# Altium schematic sheet Power.SchDoc
size OrCAD C; SheetNumber: 2; SheetTotal: 5
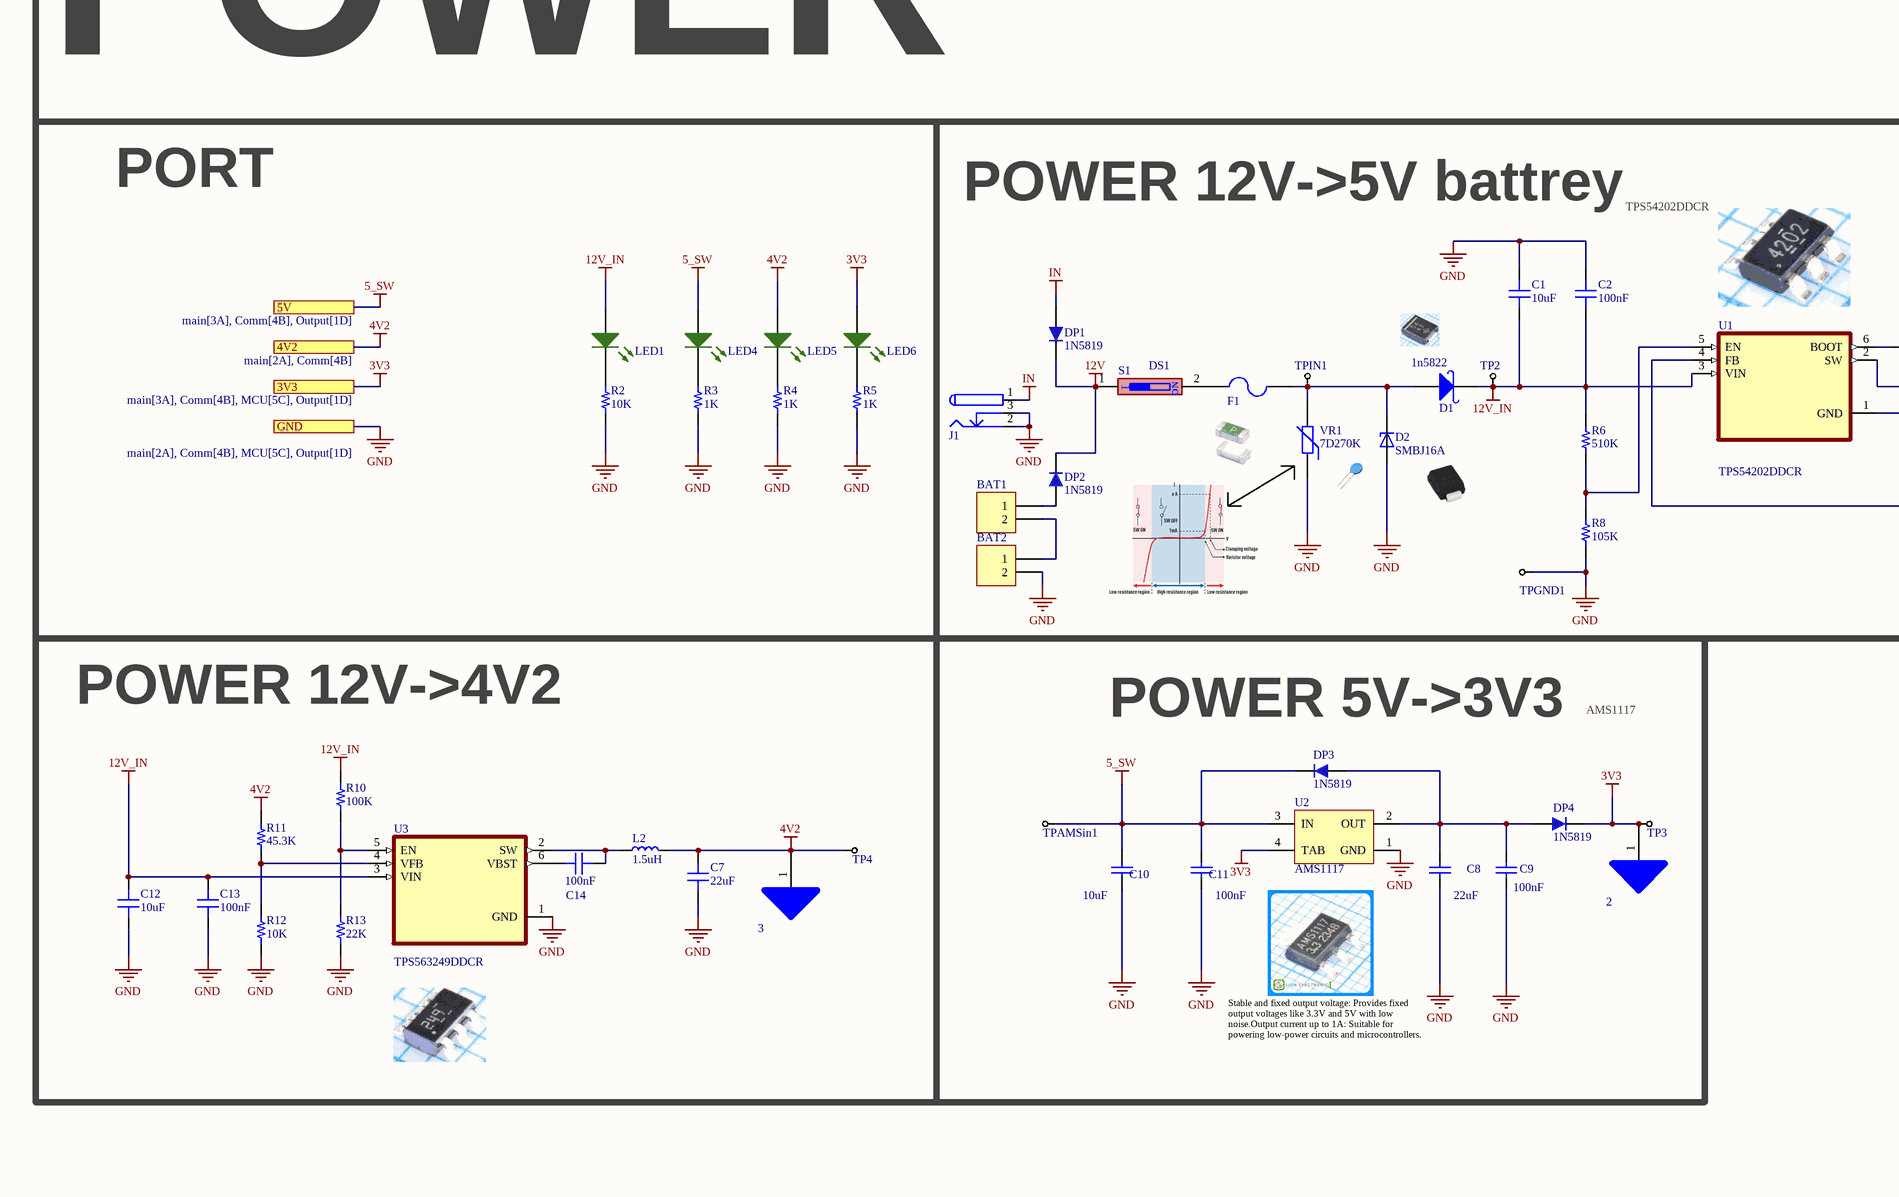
[diagram p0: Power.SchDoc, left]
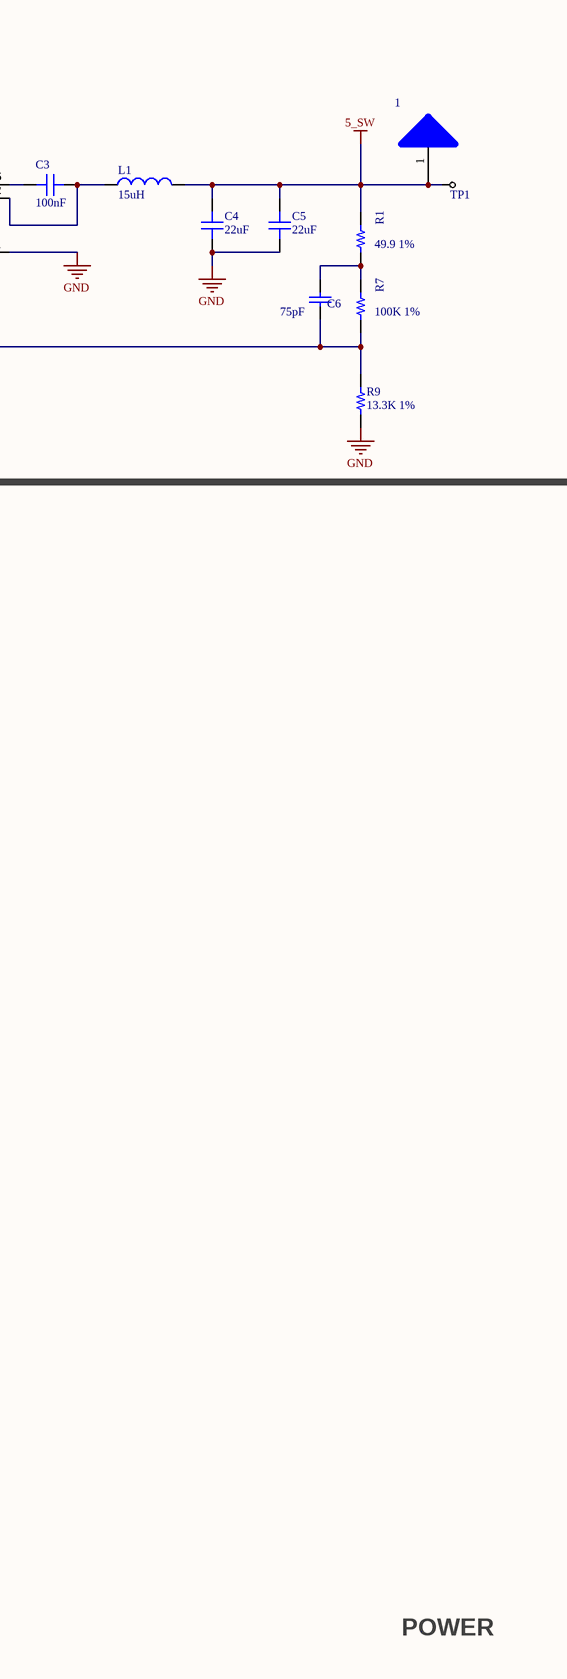
[diagram p1: Power.SchDoc, right]

## Parts
1  (no value)  [MY_TestPin]
2  (no value)  [MY_TestPin]
3  (no value)  [MY_TestPin]
BAT1  Header 2  [My_1X02]  (value not drawn)
BAT2  Header 2  [My_1X02]  (value not drawn)
C1  10uF  [CAP 0603_1608]
C2  100nF  [CAP 0603_1608]
C3  100nF  [CAP 0603_1608]
C4  22uF  [CAP 0603_1608]
C5  22uF  [CAP 0603_1608]
C6  75pF  [MY_CAP_SMD_0603]
C7  22uF  [CAP 0603_1608]
C8  22uF  [MY_CAP_SMD_0603]
C9  100nF  [MY_CAP_SMD_0603]
C10  10uF  [MY_CAP_SMD_0603]
C11  100nF  [MY_CAP_SMD_0603]
C12  10uF  [CAP 0603_1608]
C13  100nF  [CAP 0603_1608]
C14  100nF  [CAP 0603_1608]
D1  1n5822  [DO-214AB(SMC)]
D2  SMBJ16A  [DIOM4336X265N]
DP1  1N5819  [430X270D]
DP2  1N5819  [430X270D]
DP3  1N5819  [430X270D]
DP4  1N5819  [430X270D]
F1  F=3.0 A  [1206 FUSE]  (value not drawn)
J1  DC Power Jack  [DC Power Jack 1]  (value not drawn)
L1  15uH  [INDUCTOR_SMD_3A]
L2  1.5uH  [IND 7X7MM]
LED1  LED SMD 1206 GREEN  [LED_1206_GREEN]  (value not drawn)
LED4  LED SMD 1206 GREEN  [LED_1206_GREEN]  (value not drawn)
LED5  LED SMD 1206 GREEN  [LED_1206_GREEN]  (value not drawn)
LED6  LED SMD 1206 GREEN  [LED_1206_GREEN]  (value not drawn)
R1  49.9 1%  [RES 0805_2012]
R2  10K  [RES 0603_1608]
R3  1K  [RES 0603_1608]
R4  1K  [RES 0603_1608]
R5  1K  [RES 0603_1608]
R6  510K  [RES 0603_1608]
R7  100K 1%  [RES 0805_2012]
R8  105K  [RES 0603_1608]
R9  13.3K 1%  [RES 0603_1608]
R10  100K  [RES 0603_1608]
R11  45.3K  [RES 0603_1608]
R12  10K  [RES 0603_1608]
R13  22K  [RES 0603_1608]
S1  DS1  [DIP Switch x1]
TP1  Test Point  [Test Point]  (value not drawn)
TP2  Test Point  [Test Point]  (value not drawn)
TP3  Test Point  [Test Point]  (value not drawn)
TP4  Test Point  [Test Point]  (value not drawn)
TPAMSin1  Test Point  [Test Point]  (value not drawn)
TPGND1  Test Point  [Test Point]  (value not drawn)
TPIN1  Test Point  [Test Point]  (value not drawn)
U1  TPS54202DDCR  [SOT95P280X110-6N]
U2  AMS1117  [SOT223_M]
U3  TPS563249DDCR  [SOT95P280X110-6N]
VR1  7D270K  [07D XXX]

## Blocks framed on the sheet
POWER: LED1 LED4-LED6 R2-R5
POWER 12V->5V battrey: 1 BAT1 BAT2 C1-C6 D1 D2 DP1 DP2 F1 J1 L1 R1 R6-R9 S1 TP1 TP2 TPGND1 TPIN1 U1 VR1
POWER 12V->4V2: 3 C7 C12-C14 L2 R10-R13 TP4 U3
POWER 5V->3V3: 2 C8-C11 DP3 DP4 TP3 TPAMSin1 U2

## Ports
3V3 (see main[3A], Comm[4B], MCU[5C], Output[1D]), 4V2 (see main[2A], Comm[4B]), 5V (see main[3A], Comm[4B], Output[1D]), GND (see main[2A], Comm[4B], MCU[5C], Output[1D])

## Nets
3V3: 2.1 DP4.2 LED6.1(A) TP3.1(T) U2.4(TAB) ; port 3V3
4V2: 3.1 C7.2 L2.2 LED5.1(A) R11.2 TP4.1(T) ; port 4V2
5_SW: 1.1 C4.2 C5.2 C10.1 C11.1 DP3.2 L1.2 LED4.1(A) R1.1 TP1.1(T) TPAMSin1.1(T) U2.3(IN) ; port 5V
12V: DP1.2 DP2.2 S1.1
12V_IN: C1.1 C2.1 C12.2 C13.2 D1.2(K) LED1.1(A) R6.2 R10.2 TP2.1(T) U1.3(VIN) U3.3(VIN)
GND: BAT2.2 C1.2 C2.2 C4.1 C5.1 C7.1 C8.2 C9.2 C10.2 C11.2 C12.1 C13.1 D2.A J1.2 J1.3 R2.1 R3.1 R4.1 R5.1 R8.1 R9.1 R12.1 R13.1 TPGND1.1(T) U1.1(GND) U2.1(GND) U3.1(GND) VR1.1 ; port GND
IN: DP1.1 J1.1
NetBAT1_1: BAT1.1 DP2.1
NetBAT1_2: BAT1.2 BAT2.1
NetC3_1: C3.1 L1.1 U1.2(SW)
NetC3_2: C3.2 U1.6(BOOT)
NetC6_1: C6.1 R1.2 R7.1
NetC6_2: C6.2 R7.2 R9.2 U1.4(FB)
NetC8_1: C8.1 C9.1 DP3.1 DP4.1 U2.2(OUT)
NetC14_1: C14.1 L2.1 U3.2(SW)
NetC14_2: C14.2 U3.6(VBST)
NetD1_1: D1.1(A) D2.C F1.2 TPIN1.1(T) VR1.2
NetF1_1: F1.1 S1.2
NetLED1_2: LED1.2(K) R2.2
NetLED4_2: LED4.2(K) R3.2
NetLED5_2: LED5.2(K) R4.2
NetLED6_2: LED6.2(K) R5.2
NetR6_1: R6.1 R8.2 U1.5(EN)
NetR10_1: R10.1 R13.2 U3.5(EN)
NetR11_1: R11.1 R12.2 U3.4(VFB)

## Notes on the sheet
- PORT
- TPS54202DDCR
- AMS1117
- Stable and fixed output voltage: Provides fixed output voltages like 3.3V and 5V with low noise.Output current up to 1A: Suitable for powering low-power circuits and microcontrollers.
- POWER
- (in symbol DIP Switch 1) ON

## Library data of the parts
1-3 = Test Point
BAT1 BAT2 = Header 2: Header, 2-Pin; LatestRevisionDate: 17-Jul-2002; LatestRevisionNote: Re-released for DXP Platform.; Publisher: Altium Limited
C1 C12 = Cap 0603: SMT Capacitor; VALUE: 100nF
C2-C5 C7 C13 C14 = Cap 0603: SMT Capacitor
  C2 C3 C13 C14: VALUE: 100nF
  C4 C5 C7: VALUE: 22uF
C6 C8-C11 = CAP SMD_0603
D1 = 1N5822 SMD: Schottky Rectifiers; Part. No: SS34; Manufacturer: ON Semiconductor/Fairchild; Designer: Abbas Basereh; Link: https://www.aliexpress.com/item/Free-shipping-100pcs-1n5822-sma-smd-do-214ac-Schottky-diode-ss34/32337482329.html?spm=2114.01010208.3.1.zLZDsP&ws_ab_test=searchweb0_0,searchweb201602_4_10065_10068_10084_10083_10080_10082_10081_10060_10061_10062_10056_10055_10054_10059_10099_10078_10079_427_10073_10103_10102_10096_10052_10050_10051,searchweb201603_4&btsid=6e50dc92-ac69-45bc-a19e-209af19ce602; Link: http://www.tme.eu/en/details/ss34/smd-schottky-diodes/vishay/ss34-e357t/; Link: http://www.digikey.com/product-detail/en/on-semiconductor-fairchild/SS34/SS34FSCT-ND/2094459; Data: 16-12-2016
D2 = SMBJ16A: 600W, 18.8V, 5%, Unidirectional, TVS; MF: Taiwan Semiconductor; MP: SMBJ16A; SnapEDA_Link: https://www.snapeda.com/parts/SMBJ16A/Taiwan+Semiconductor/view-part/?ref=snap; Check_prices: https://www.snapeda.com/parts/SMBJ16A/Taiwan+Semiconductor/view-part/?ref=eda; Price: None; Availability: In Stock; Purchase-URL: https://pricing.snapeda.com/search/part/SMBJ16A/?ref=eda; Package: SMD-2-2 Avago; Value: *
DP1-DP4 = 1N5819: Schottkey Rectifiers - SMD; Designer: Abbas Basereh; Data: 16-12-2016; Link: *; Part. No: *
F1 = Fuse SMD1206: SMD Fuses 1206; Designer: Abbas Basereh; Desc.: SMD Fuses 1206; Data: 16-12-2016
J1 = DC Power Jack: DC Power Jack. Center Pin 2.5mm. Diameter: 5.7mm; Designer: Ali Hafizi; Company: Personal; Project Name: Laser; Adding Date: 10/21/2009
L1 = INDUCTOR_SMD_3A
L2 = Ind POWER 7X7mm (SMD): SMD Power Choke Coil 1.5uH 18A 7.3x6.6mm / or / SMD Inductor 1.5uH 3.8A 1008; Value: 1.5uH; ComponentLink1Description: New link; ComponentLink1URL: https://lionelectronic.ir/products/5584-TMPC0603H-1R5MG-D; ComponentLink2Description: New link 1; ComponentLink2URL: https://lionelectronic.ir/products/4663-DFE252012F-1R5M%3DP2
R1 R7 = Res 0805: SMT Resistor; VALUE: 1K
R2-R6 R8 R9 R13 = Res 0603: SMT Resistor; VALUE: 100K
R10-R12 = Res 0603: SMT Resistor
  R10: VALUE: 100K
  R11: VALUE: 45.3K
  R12: VALUE: 10K
S1 = DIP Switch 1: 1 BIT DIP Switch
U1 = TPS54202HDDCR: 4.5V to 28V Input, 2A Output, Synchronous Step-Down Voltage Converter 6-SOT-23-THIN -40 to 125; MF: Texas Instruments; MP: TPS54202HDDCR; Price: None; Availability: Good; Check_prices: https://www.snapeda.com/parts/TPS54202HDDCR/Texas%20Instruments/view-part/573706/?ref=eda; Package: SOT-23-THN-6 Texas Instruments; Purchase-URL: https://pricing.snapeda.com/search/part/TPS54202HDDCR/?ref=eda; SnapEDA_Link: https://www.snapeda.com/parts/TPS54202HDDCR/Texas%20Instruments/view-part/573706/?ref=snap; Value: *; ComponentLink1Description: Buy; ComponentLink1URL: https://lionelectronic.ir/products/792-TPS54202DDCR
U2 = AMS1117-x.x: x.x Volt, 800mA Low-Dropout Linear Regulator, 4-pin SOT-223; Designer: Ali Hafizi; Data: 16-12-2016
U3 = TPS563249DDCR: 17-V, 3-A, constant 1.4-MHz synchronous step-down voltage regulator; MF: Texas Instruments; SnapEDA_Link: https://www.snapeda.com/parts/TPS563249DDCR/Texas+Instruments/view-part/?ref=snap; Package: SOT-23-THN-6 Texas Instruments; Value: *; MP: TPS563249DDCR; Check_prices: https://www.snapeda.com/parts/TPS563249DDCR/Texas+Instruments/view-part/?ref=eda; ComponentLink1Description: Buy; ComponentLink1URL: https://lionelectronic.ir/products/5572-TPS563249DDCR
VR1 = VARISTOR (VDR): VARISTORS; Manufacturer: china-canada-philipina; Designer: Abbas Basereh; VALUE: xxDxxx; Models: MOV-VDR-COV; Data: 2017-1-5; Link: digikey.com; PUBLISHER: ABBAS BASEREH